# EasyEDA Pro project Designs.eprj, schematic Schematic6
Board Name: ProgramCounter; Create Date: 2026-04-10; Page Name: P1; Project Name: Jarvis; Schematic Name: Schematic6; Update Date: 2026-04-13; Company: EasyEDA.com; Page Size: A4; Version: V1.0
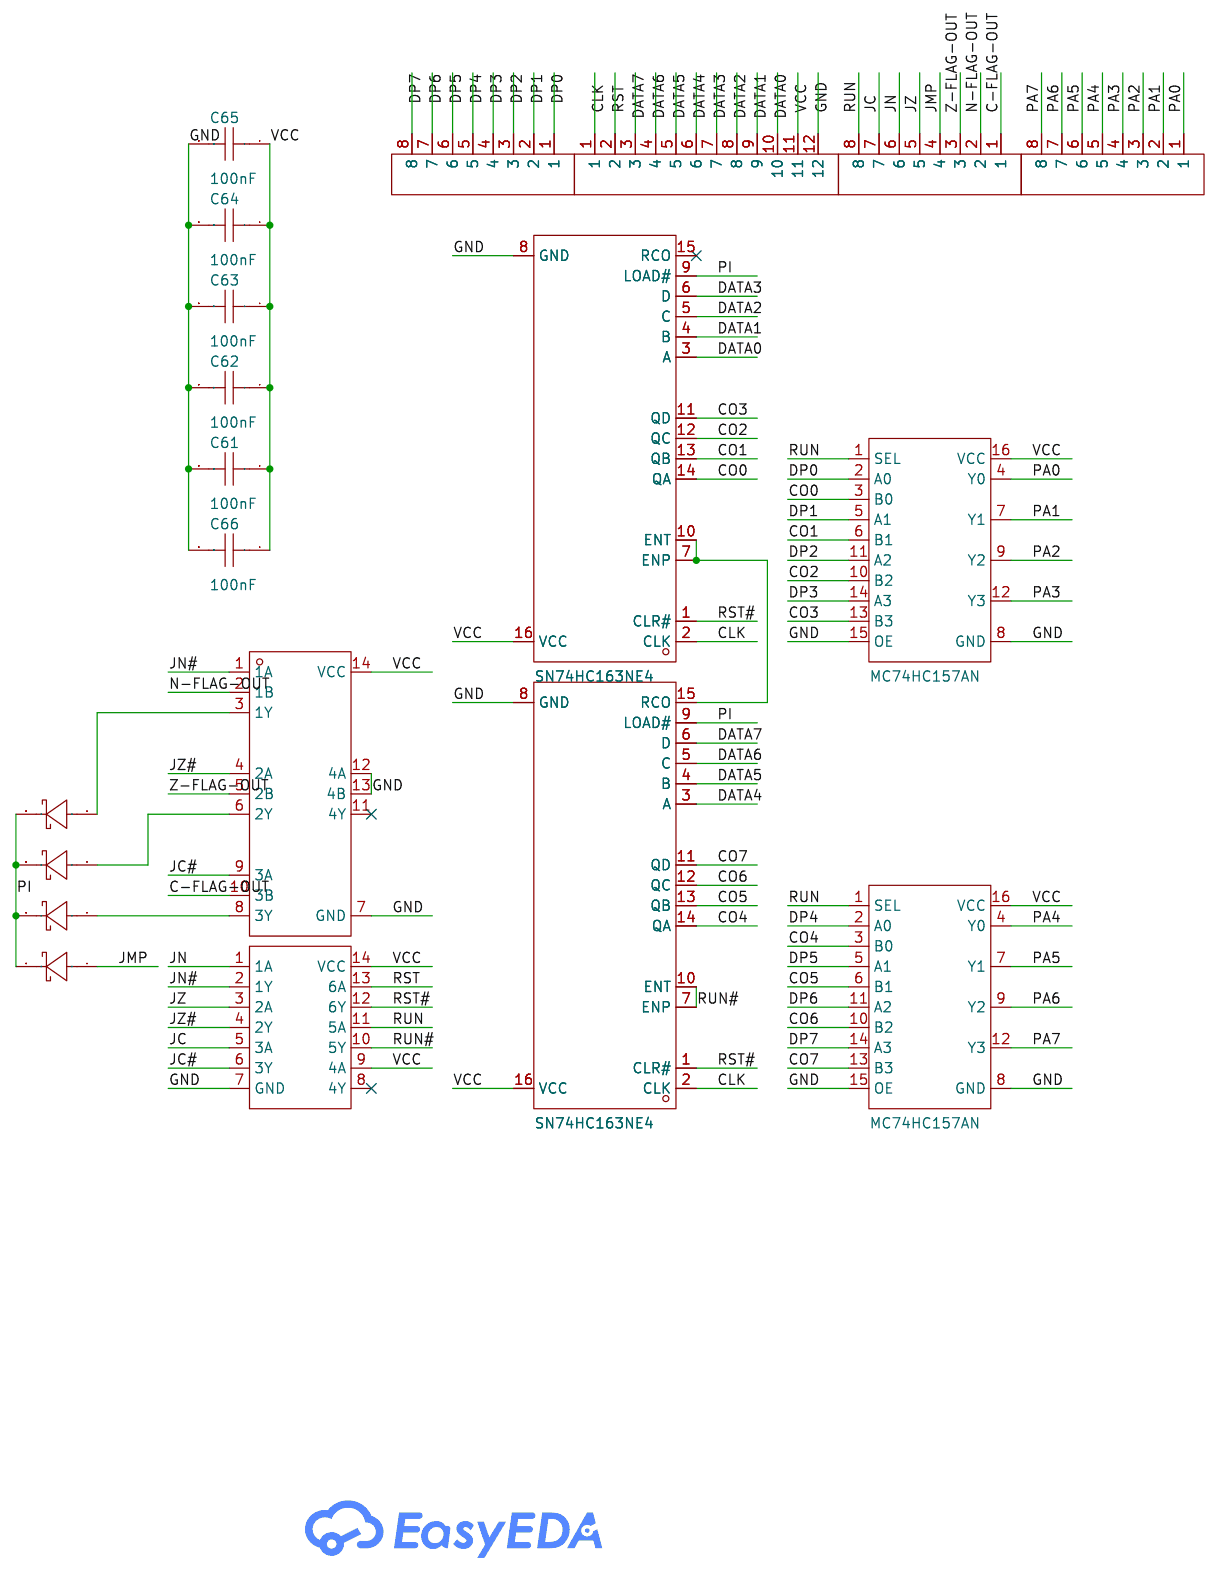
[diagram p1: schematic sheet]

## Parts
C61  100nF  [CAP-TH_L5.0-W2.5-P5.00-D1.0]
C62  100nF  [CAP-TH_L5.0-W2.5-P5.00-D1.0]
C63  100nF  [CAP-TH_L5.0-W2.5-P5.00-D1.0]
C64  100nF  [CAP-TH_L5.0-W2.5-P5.00-D1.0]
C65  100nF  [CAP-TH_L5.0-W2.5-P5.00-D1.0]
C66  100nF  [CAP-TH_L5.0-W2.5-P5.00-D1.0]
U210  SN74HC04N(LX)  [DIP-14_L19.6-W6.4-P2.54-LS7.6-BL]
U321  SN74HC163NE4  [PDIP-16_L19.3-W6.4-P2.54-LS7.94-BL]
U322  MC74HC157AN  [PDIP-16_L19.3-W6.4-P2.54-LS7.94-BL]
U323  SN74HC163NE4  [PDIP-16_L19.3-W6.4-P2.54-LS7.94-BL]
U324  MC74HC157AN  [PDIP-16_L19.3-W6.4-P2.54-LS7.94-BL]
U325  SN74HC08NE4  [PDIP-14_L19.3-W6.5-P2.54-LS7.6-BL]
U353  1N4007-DIODE  [DO-41_BD2.4-L4.7-P8.70-D0.8-FD]
U354  1N4007-DIODE  [DO-41_BD2.4-L4.7-P8.70-D0.8-FD]
U355  1N4007-DIODE  [DO-41_BD2.4-L4.7-P8.70-D0.8-FD]
U356  TH2.54_8P_0.6  [HDR-TH_8P-P2.54-V-M-3]
U359  1N4007-DIODE  [DO-41_BD2.4-L4.7-P8.70-D0.8-FD]
U386  D22030200553-HDR-TH_12P-P2.54-V-F  [HDR-TH_12P-P2.54-V-F]
U387  TH2.54_8P_0.6  [HDR-TH_8P-P2.54-V-M-3]
U388  TH2.54_8P_0.6  [HDR-TH_8P-P2.54-V-M-3]

## Library data of the parts
C61-C66 = 178MU0006: LCSC Part Name: 100nF ±10% 50V; Supplier Part: C5632430; Manufacturer: KNSCHA(科尼盛); Supplier Footprint: 插件,P=2.54mm; JLCPCB Part Class: Extended Part; Datasheet: https://item.szlcsc.com/datasheet/178MU0006/6552585.html; Supplier: LCSC; Tolerance: ±10%; Voltage Rating: 50V; Temperature Coefficient: X7R; Pin Spacing: 2.54mm
U210 = SN74HC04N(LX): LCSC Part Name: 集成电路; Supplier Part: C22436641; Manufacturer: LX(灵星芯微); Supplier Footprint: DIP-14; JLCPCB Part Class: Extended Part; Datasheet: https://item.szlcsc.com/datasheet/SN74HC04N(LX)/24070577.html; Supplier: LCSC; Voltage - Supply: 2V~6V; Quiescent Current(Iq): 2uA; Number of Circuits: 6; Input Logic Level - High: 1.5V~4.2V; Input Logic Level -Low: 500mV~1.8V; Output Logic Level - High: 4.4V；5.9V；1.9V; Output Logic Level - Low: 260mV；260mV；100mV; Propagation Delay: 14ns@6V,50pF; Series: 74HC Series; Operating Temperature: -40℃~+125℃
U321 U323 = SN74HC163NE4: Supplier Part: C20345717; Manufacturer: TI(德州仪器); Supplier Footprint: PDIP-16; JLCPCB Part Class: Extended Part; Datasheet: https://atta.szlcsc.com/upload/public/pdf/source/20240116/FC6F7C80FC5EB51F2BFA3EE0E58B1708.pdf; Supplier: LCSC
U322 U324 = MC74HC157AN: Supplier Part: C3231585; Manufacturer: onsemi(安森美); Supplier Footprint: PDIP-16; Datasheet: https://atta.szlcsc.com/upload/public/pdf/source/20230915/AA5F4BE3BD1C30F26D22E0E41BE72F14.pdf; Supplier: LCSC; Type: Data Selector/Multiplexers; Voltage Supply Source: Single supply; Supply Voltage: 2V~6V; Sink Current: 7.8mA; Source Current: 7.8mA; Operating temperature: -55℃~+125℃
U325 = SN74HC08NE4: Supplier Part: C20345708; Manufacturer: TI(德州仪器); Supplier Footprint: PDIP-14; JLCPCB Part Class: Extended Part; Datasheet: https://item.szlcsc.com/datasheet/SN74HC08NE4/21671235.html; Supplier: LCSC; Logic Type: AND Gate; Number of Channels: 4; Voltage - Supply: 2V~6V; Quiescent Current: 20uA; Current - Output Low(IOL): 5.2mA; Current - Output High(IOH): 5.2mA; Input Logic Level - High: 1.5V；4.2V；3.15V; Input Logic Level - Low: 1.35V；500mV；1.8V; Output Logic Level - High: 4.4V；5.9V；1.9V; Output Logic Level - Low: 330mV；260mV；100mV; Series: 74HC; Propagation Delay: 25ns@4.5V,50pF; Operating Temperature: -40℃~+85℃; Input Number: 2
U353-U355 U359 = 1N4007-DIODE: Supplier Part: C9900005663; Supplier Footprint: DO-41; JLCPCB Part Class: Extended Part; Supplier: LCSC
U356 U387 U388 = TH2.54_8P_0.6: Supplier Part: C9900018349; Supplier Footprint: HDR-TH-8P; JLCPCB Part Class: Extended Part; Supplier: LCSC
U386 = D22030200553-HDR-TH_12P-P2.54-V-F: Supplier Part: C9900009321; JLCPCB Part Class: Extended Part; Supplier: LCSC

## Nets
GND: C61.2 C62.2 C63.2 C64.2 C65.2 C66.2 U210.7(GND) U321.8(GND) U322.8(GND) U322.15(OE) U323.8(GND) U324.8(GND) U324.15(OE) U325.7(GND) U325.12(4A) U325.13(4B) U386.12
VCC: C61.1 C62.1 C63.1 C64.1 C65.1 C66.1 U210.9(4A) U210.14(VCC) U321.16(VCC) U322.16(VCC) U323.16(VCC) U324.16(VCC) U325.14(VCC) U386.11
C-FLAG-OUT: U325.10(3B) U388.1
CLK: U321.2(CLK) U323.2(CLK) U386.1
CO0: U321.14(QA) U322.3(B0)
CO1: U321.13(QB) U322.6(B1)
CO2: U321.12(QC) U322.10(B2)
CO3: U321.11(QD) U322.13(B3)
CO4: U323.14(QA) U324.3(B0)
CO5: U323.13(QB) U324.6(B1)
CO6: U323.12(QC) U324.10(B2)
CO7: U323.11(QD) U324.13(B3)
DATA0: U321.3(A) U386.10
DATA1: U321.4(B) U386.9
DATA2: U321.5(C) U386.8
DATA3: U321.6(D) U386.7
DATA4: U323.3(A) U386.6
DATA5: U323.4(B) U386.5
DATA6: U323.5(C) U386.4
DATA7: U323.6(D) U386.3
DP0: U322.2(A0) U356.1
DP1: U322.5(A1) U356.2
DP2: U322.11(A2) U356.3
DP3: U322.14(A3) U356.4
DP4: U324.2(A0) U356.5
DP5: U324.5(A1) U356.6
DP6: U324.11(A2) U356.7
DP7: U324.14(A3) U356.8
JC: U210.5(3A) U388.7
JC#: U210.6(3Y) U325.9(3A)
JMP: U359.1(A) U388.4
JN: U210.1(1A) U388.6
JN#: U210.2(1Y) U325.1(1A)
JZ: U210.3(2A) U388.5
JZ#: U210.4(2Y) U325.4(2A)
N-FLAG-OUT: U325.2(1B) U388.2
PA0: U322.4(Y0) U387.1
PA1: U322.7(Y1) U387.2
PA2: U322.9(Y2) U387.3
PA3: U322.12(Y3) U387.4
PA4: U324.4(Y0) U387.5
PA5: U324.7(Y1) U387.6
PA6: U324.9(Y2) U387.7
PA7: U324.12(Y3) U387.8
PI: U321.9(LOAD#) U323.9(LOAD#) U353.2(K) U354.2(K) U355.2(K) U359.2(K)
RST: U210.13(6A) U386.2
RST#: U210.12(6Y) U321.1(CLR#) U323.1(CLR#)
RUN: U210.11(5A) U322.1(SEL) U324.1(SEL) U388.8
RUN#: U210.10(5Y) U323.7(ENP) U323.10(ENT)
Z-FLAG-OUT: U325.5(2B) U388.3
$1N798: U325.6(2Y) U354.1(A)
$1N830: U325.3(1Y) U355.1(A)
$1N833: U325.8(3Y) U353.1(A)
$1N887: U321.7(ENP) U321.10(ENT) U323.15(RCO)

Not connected (* = marked no-connect by the designer): U210 8(4Y)*; U321 15(RCO)*; U325 11(4Y)*
